# EasyEDA Pro project URADORRY-SUN.eprj, board Sub - MAX3421E/Rev1.0
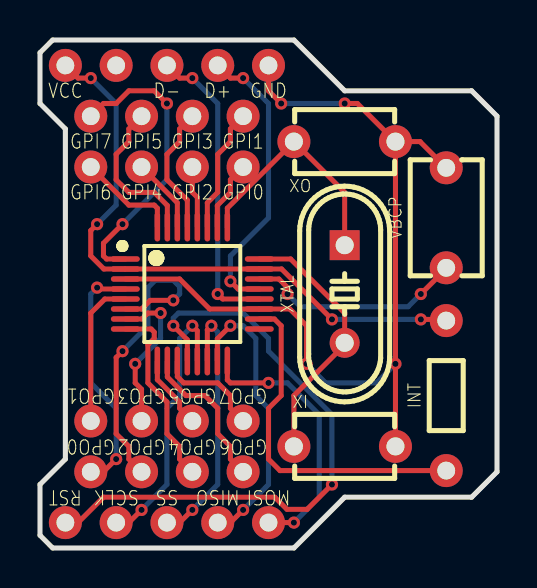
[diagram p4: board, top side]
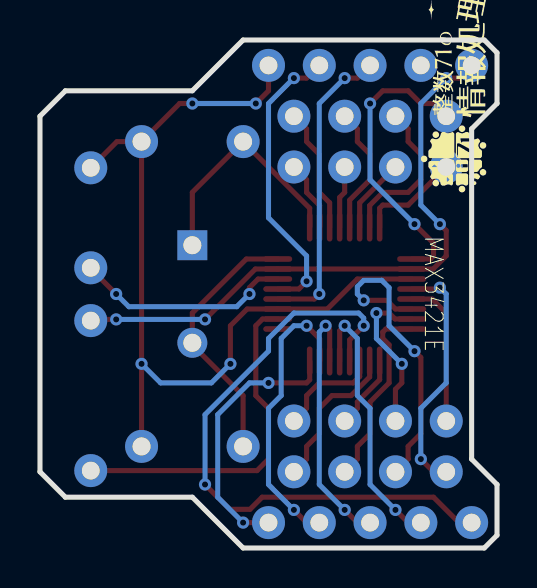
[diagram p5: board, bottom side, seen from below]

Outline 22.86 x 25.4 mm; copper layers: Top Layer, Bottom Layer. Coordinates in mm from the lower left corner of the outline.
Outline path: 0,24.77 0.63,25.4 12.7,25.4 15.24,22.86 21.59,22.86 22.86,21.59 22.86,3.81 21.59,2.54 15.24,2.54 12.7,0 0.63,0 0,0.64 0,3.17 1.27,4.45 1.27,20.95 0,22.23 0,24.77
Stack: Top Layer 0.035mm / Dielectric1 1.51mm FR4 er 4.5 / Bottom Layer 0.035mm

## Design rules (mm)
template: JLCPCB Capability(Two Layers Board)
spacing copperThickness1oz (default): track to track 0.102, other pairs 0.152 to 0.3
spacing copperThickness2oz: track to track 0.203, other pairs 0.152 to 0.3
track width copperThickness1oz (default): min 0.127, default 0.254, max 2.54
track width copperThickness2oz: min 0.203, default 0.254, max 2.54
differential pair differentialPair (default): width min 0.127, default 0.254, max 2.54; gap min 0.152, default 0.152
via viaSize (default): diameter min 0.5, default 0.61, max 10; hole min 0.3, default 0.305, max 6.3

## Placement (name value [footprint] x y rotation side)
INT  2.2kΩ  [res-th_bd1.7-l3.5-p7.50-d0.5]  20.32 7.62 270 top
MAX3421E  MAX3421EEHJ+T  [TQFP-32_L5.0-W5.0-P0.50-LS7.0-BL]  7.62 12.7 270 top
NOREF  -  [Pad_e85]  5.08 21.59 0 top
NOREF#2  -  [Pad_e86]  2.54 19.05 0 top
NOREF#3  -  [Pad_e91]  5.08 6.35 0 top
NOREF#4  -  [Pad_e82]  7.62 19.05 0 top
NOREF#5  -  [Pad_e93]  7.62 6.35 0 top
NOREF#6  -  [Pad_e1977]  3.81 24.13 0 top
NOREF#7  -  [Pad_e84]  5.08 19.05 0 top
NOREF#8  -  [Pad_e87]  2.54 21.59 0 top
NOREF#9  -  [Pad_e75]  11.43 1.27 0 top
NOREF#10  -  [Pad_e74]  1.27 24.13 0 top
NOREF#11  -  [Pad_e92]  7.62 3.81 0 top
NOREF#12  -  [Pad_e79]  1.27 1.27 0 top
NOREF#13  -  [Pad_e90]  5.08 3.81 0 top
NOREF#14  -  [Pad_e77]  6.35 1.27 0 top
NOREF#15  -  [Pad_e73]  11.43 24.13 0 top
NOREF#16  -  [Pad_e95]  10.16 6.35 0 top
NOREF#17  -  [Pad_e78]  3.81 1.27 0 top
NOREF#18  -  [Pad_e80]  10.16 19.05 0 top
NOREF#19  -  [Pad_e71]  8.89 24.13 0 top
NOREF#20  -  [Pad_e81]  10.16 21.59 0 top
NOREF#21  -  [Pad_e94]  10.16 3.81 0 top
NOREF#22  -  [Pad_e72]  6.35 24.13 0 top
NOREF#23  -  [Pad_e88]  2.54 6.35 0 top
NOREF#24  -  [Pad_e89]  2.54 3.81 0 top
NOREF#25  -  [Pad_e83]  7.62 21.59 0 top
NOREF#26  -  [Pad_e76]  8.89 1.27 0 top
VBCP  100nF  [cap-th_l5.8-w3.6-p5.0-d0.6]  20.32 16.51 270 top
XI  20pF  [cap-th_l5.0-w3.2-p5.08-d0.6]  15.24 5.08 180 top
XO  20pF  [cap-th_l5.0-w3.2-p5.08-d0.6]  15.24 20.32 180 top
XTAL  12MHz  [HC-49US_L11.5-W4.5-P4.88]  15.24 12.7 270 top

## Footprints (pads in the part's own frame, mm; a bottom-side part is the same pattern mirrored in y, then rotated)
cap-th_l5.0-w3.2-p5.08-d0.6
  round 1.651 hole 0.9x0.889: 1(-2.54,0) 2(2.54,0)
cap-th_l5.8-w3.6-p5.0-d0.6
  round 1.651 hole 0.889: 1(-2.5,0) 2(2.5,0)
HC-49US_L11.5-W4.5-P4.88
  rect 1.5x1.5 hole 0.9: 1(-2.44,0)
  round 1.5 hole 0.9: 2(2.44,0)
Pad_e71
  round 1.651 hole 0.889: 1(0,0)
Pad_e72
  round 1.651 hole 0.889: 1(0,0)
Pad_e73
  round 1.651 hole 0.889: 1(0,0)
Pad_e74
  round 1.651 hole 0.889: 1(0,0)
Pad_e75
  round 1.651 hole 0.889: 1(0,0)
Pad_e76
  round 1.651 hole 0.889: 1(0,0)
Pad_e77
  round 1.651 hole 0.889: 1(0,0)
Pad_e78
  round 1.651 hole 0.889: 1(0,0)
Pad_e79
  round 1.651 hole 0.889: 1(0,0)
Pad_e80
  round 1.651 hole 0.889: 1(0,0)
Pad_e81
  round 1.651 hole 0.889: 1(0,0)
Pad_e82
  round 1.651 hole 0.889: 1(0,0)
Pad_e83
  round 1.651 hole 0.889: 1(0,0)
Pad_e84
  round 1.651 hole 0.889: 1(0,0)
Pad_e85
  round 1.651 hole 0.889: 1(0,0)
Pad_e86
  round 1.651 hole 0.889: 1(0,0)
Pad_e87
  round 1.651 hole 0.889: 1(0,0)
Pad_e88
  round 1.651 hole 0.889: 1(0,0)
Pad_e89
  round 1.651 hole 0.889: 1(0,0)
Pad_e90
  round 1.651 hole 0.889: 1(0,0)
Pad_e91
  round 1.651 hole 0.889: 1(0,0)
Pad_e92
  round 1.651 hole 0.889: 1(0,0)
Pad_e93
  round 1.651 hole 0.889: 1(0,0)
Pad_e94
  round 1.651 hole 0.889: 1(0,0)
Pad_e95
  round 1.651 hole 0.889: 1(0,0)
Pad_e1977
  round 1.651 hole 0.889: 1(0,0)
res-th_bd1.7-l3.5-p7.50-d0.5
  round 1.651 hole 0.889: 1(-3.75,0) 2(3.75,0)
TQFP-32_L5.0-W5.0-P0.50-LS7.0-BL
  oval 0.28x1.45 smd: 1(-1.75,-3.35) 2(-1.25,-3.35) 3(-0.75,-3.35) 4(-0.25,-3.35) 5(0.25,-3.35) 6(0.75,-3.35) 7(1.25,-3.35) 8(1.75,-3.35) 17(1.75,3.35) 18(1.25,3.35) 19(0.75,3.35) 20(0.25,3.35) 21(-0.25,3.35) 22(-0.75,3.35) 23(-1.25,3.35) 24(-1.75,3.35)
  oval 1.45x0.28 smd: 9(3.35,-1.75) 10(3.35,-1.25) 11(3.35,-0.75) 12(3.35,-0.25) 13(3.35,0.25) 14(3.35,0.75) 15(3.35,1.25) 16(3.35,1.75) 25(-3.35,1.75) 26(-3.35,1.25) 27(-3.35,0.75) 28(-3.35,0.25) 29(-3.35,-0.25) 30(-3.35,-0.75) 31(-3.35,-1.25) 32(-3.35,-1.75)

## Nets
GND: MAX3421E.3 MAX3421E.19 NOREF#15.1 VBCP.1 XI.1 XO.1
+3.3V/MX: INT.1 MAX3421E.2 MAX3421E.23 NOREF#10.1
D+/MX: MAX3421E.21 NOREF#19.1
D-/MX: MAX3421E.20 NOREF#22.1
GPI0: MAX3421E.26 NOREF#18.1
GPI1: MAX3421E.27 NOREF#20.1
GPI2: MAX3421E.28 NOREF#4.1
GPI3: MAX3421E.29 NOREF#25.1
GPI4: MAX3421E.30 NOREF#7.1
GPI5: MAX3421E.31 NOREF.1
GPI6: MAX3421E.32 NOREF#2.1
GPI7: MAX3421E.1 NOREF#8.1
GPO0: MAX3421E.4 NOREF#24.1
GPO1: MAX3421E.5 NOREF#23.1
GPO2: MAX3421E.6 NOREF#13.1
GPO3: MAX3421E.7 NOREF#3.1
GPO4: MAX3421E.8 NOREF#11.1
GPO5: MAX3421E.9 NOREF#5.1
GPO6: MAX3421E.10 NOREF#21.1
GPO7: MAX3421E.11 NOREF#16.1
INT: INT.2 MAX3421E.18
MISO/MX: MAX3421E.15 NOREF#26.1
MOSI/MX: MAX3421E.16 NOREF#9.1
RST/MX: MAX3421E.12 NOREF#12.1
SCLK/MX: MAX3421E.13 NOREF#17.1
SS/MX: MAX3421E.14 NOREF#14.1
VBCP: MAX3421E.22 VBCP.2
XI: MAX3421E.24 XI.2 XTAL.2
XO: MAX3421E.25 XO.2 XTAL.1

Pads without a net: MAX3421E 17; NOREF#6 1

## Via types
v1: diameter 0.61, hole 0.305, Top Layer to Bottom Layer, 32 vias

## Routing (per net, layer and track width the routed paths; a pad name or vN(x,y) marks a point on that pad's centre or on a via; arc(x,y) is an arc through that point)
GND: length 44.2
  Top Layer w0.254: XI.1 v1(17.78,9.21) XO.1 ; XO.1 19.01,20.32 VBCP.1 ; XO.1 15.88,22.23 v1(15.24,22.23) ; MAX3421E.3 6.99,13.45 8.49,11.95 MAX3421E.19 12.5,11.95 13.34,11.11 v1(13.34,9.21) ; NOREF#15.1 11.43,22.86 v1(12.06,22.23)
  Bottom Layer w0.254: v1(17.78,9.21) 16.83,8.26 14.29,8.26 v1(13.34,9.21) ; v1(12.06,22.23) v1(15.24,22.23)
+3.3V/MX: length 30.6
  Top Layer w0.254: NOREF#10.1 1.91,23.5 v1(2.54,23.5) ; v1(14.61,11.43) 12.09,13.95 MAX3421E.23 MAX3421E.2 3.19,13.95 2.54,14.61 2.54,15.88 v1(2.86,16.19) ; INT.1 20.26,11.43 v1(19.05,11.43)
  Bottom Layer w0.254: v1(2.86,16.19) 3.81,17.14 3.81,22.23 v1(2.54,23.5) ; v1(14.61,11.43) v1(19.05,11.43)
D+/MX: length 14.6
  Top Layer w0.254: NOREF#19.1 9.53,23.5 v1(10.16,23.5) ; v1(9.53,13.34) 9.91,12.95 MAX3421E.21
  Bottom Layer w0.254: v1(10.16,23.5) 11.43,22.23 11.43,16.51 9.53,14.61 v1(9.53,13.34)
D-/MX: length 15
  Top Layer w0.254: v1(7.62,23.5) 6.99,23.5 NOREF#22.1 ; v1(8.89,12.7) 9.14,12.45 MAX3421E.20
  Bottom Layer w0.254: v1(7.62,23.5) 8.89,22.23 v1(8.89,12.7)
GPI0: length 3.5
  Top Layer w0.254: MAX3421E.26 8.87,17.12 9.53,17.78 9.53,18.42 NOREF#18.1
GPI1: length 6.3
  Top Layer w0.254: NOREF#20.1 9.53,20.95 9.53,20.32 8.89,19.69 8.89,17.78 8.37,17.26 MAX3421E.27
GPI2: length 3.1
  Top Layer w0.254: NOREF#4.1 7.62,17.78 7.87,17.53 MAX3421E.28
GPI3: length 6.5
  Top Layer w0.254: MAX3421E.29 7.37,17.39 6.35,18.42 6.35,19.69 6.99,20.32 6.99,20.95 NOREF#25.1
GPI4: length 3.7
  Top Layer w0.254: NOREF#7.1 6.87,17.26 MAX3421E.30
GPI5: length 7.9
  Top Layer w0.254: MAX3421E.31 6.37,17.12 5.72,17.78 4.44,17.78 3.81,18.42 3.81,19.69 4.44,20.32 4.44,20.95 NOREF.1
GPI6: length 5.1
  Top Layer w0.254: MAX3421E.32 5.87,16.99 5.72,17.14 4.44,17.14 NOREF#2.1
GPI7: length 14.7
  Top Layer w0.254: v1(6.35,22.23) 5.72,22.86 4.44,22.86 3.81,22.23 3.18,22.23 NOREF#8.1 ; v1(4.13,16.19) 3.18,15.24 3.18,14.61 3.33,14.45 MAX3421E.1
  Bottom Layer w0.254: v1(4.13,16.19) 6.35,18.42 v1(6.35,22.23)
GPO0: length 12.2
  Top Layer w0.254: NOREF#24.1 3.18,3.81 v1(3.81,4.45) ; v1(2.86,13.02) 2.93,12.95 MAX3421E.4
  Bottom Layer w0.254: v1(3.81,4.45) 3.81,6.98 2.54,8.26 2.54,12.7 v1(2.86,13.02)
GPO1: length 7.4
  Top Layer w0.254: MAX3421E.5 3.24,12.45 2.54,11.75 NOREF#23.1
GPO2: length 15.7
  Top Layer w0.254: v1(4.13,9.84) 3.81,9.53 3.81,5.72 4.44,5.08 4.44,4.45 NOREF#13.1 ; MAX3421E.6 5.08,11.95 5.51,12.38 v1(6.67,12.38)
  Bottom Layer w0.254: v1(6.67,12.38) 6.99,12.7 6.99,13.06 6.67,13.38 5.76,13.38 5.4,13.02 5.4,11.11 v1(4.13,9.84)
GPO3: length 7.9
  Top Layer w0.254: v1(6.03,11.75) 5.4,11.75 5.1,11.45 MAX3421E.7 ; NOREF#3.1 5.08,7.94 4.76,8.26 v1(4.76,9.21)
  Bottom Layer w0.254: v1(4.76,9.21) 6.03,10.48 v1(6.03,11.75)
GPO4: length 9.5
  Top Layer w0.254: MAX3421E.8 5.56,10.95 5.72,10.8 5.72,10.48 5.4,10.16 5.4,8.26 6.35,7.3 6.35,5.72 6.99,5.08 6.99,4.45 NOREF#11.1
GPO5: length 3.7
  Top Layer w0.254: NOREF#5.1 6.99,6.98 6.99,7.3 5.87,8.42 MAX3421E.9
GPO6: length 7.7
  Top Layer w0.254: NOREF#21.1 9.53,4.45 9.53,5.08 8.89,5.72 8.89,6.98 8.25,7.62 7.3,7.62 6.37,8.55 MAX3421E.10
GPO7: length 5.4
  Top Layer w0.254: NOREF#16.1 9.53,6.98 9.53,7.62 8.89,8.26 7.19,8.26 6.87,8.57 MAX3421E.11
INT: length 17.3
  Top Layer w0.254: MAX3421E.18 11.73,11.45 12.06,11.11 12.06,7.62 11.43,6.98 11.43,4.45 12,3.87 INT.2
MISO/MX: length 14.5
  Top Layer w0.254: MAX3421E.15 8.87,10.46 v1(9.53,11.11) ; v1(10.16,1.91) 9.53,1.27 NOREF#26.1
  Bottom Layer w0.254: v1(10.16,1.91) 11.43,3.17 11.43,6.98 10.8,7.62 10.8,10.48 10.16,11.11 v1(9.53,11.11)
MOSI/MX: length 13.5
  Top Layer w0.254: MAX3421E.16 9.37,8.41 9.53,8.26 v1(11.43,8.26) ; v1(12.7,1.27) NOREF#9.1
  Bottom Layer w0.254: v1(11.43,8.26) 12.38,8.26 13.97,6.67 13.97,2.54 v1(12.7,1.27)
RST/MX: length 31.1
  Top Layer w0.254: v1(14.61,3.17) 13.36,1.93 12.35,1.93 11.75,2.54 3.18,2.54 1.91,1.27 NOREF#12.1 ; v1(6.67,11.11) 7.37,10.41 MAX3421E.12
  Bottom Layer w0.254: v1(14.61,3.17) 14.61,6.67 11.43,9.84 11.43,10.48 10.16,11.75 6.92,11.75 6.67,11.49 v1(6.67,11.11)
SCLK/MX: length 13.7
  Top Layer w0.254: MAX3421E.13 7.87,10.86 v1(7.62,11.11) ; v1(5.08,1.91) 4.44,1.27 NOREF#17.1
  Bottom Layer w0.254: v1(5.08,1.91) 6.35,3.17 6.35,6.98 6.99,7.62 6.99,10.48 v1(7.62,11.11)
SS/MX: length 13.2
  Top Layer w0.254: MAX3421E.14 8.37,10.91 v1(8.57,11.11) ; NOREF#14.1 6.99,1.27 v1(7.62,1.91)
  Bottom Layer w0.254: v1(8.57,11.11) 8.89,10.8 8.89,3.17 v1(7.62,1.91)
VBCP: length 10.9
  Top Layer w0.254: v1(12.38,12.7) 12.38,13.02 11.95,13.45 MAX3421E.22 ; v1(19.05,12.7) 20.32,13.97 VBCP.2
  Bottom Layer w0.254: v1(12.38,12.7) 13.02,12.06 18.41,12.06 v1(19.05,12.7)
XI: length 13.1
  Top Layer w0.254: XI.2 12.7,7.62 15.24,10.16 XTAL.2 15.24,11.75 12.54,14.45 MAX3421E.24
XO: length 11.9
  Top Layer w0.254: XTAL.1 15.24,17.78 XO.2 9.37,16.99 MAX3421E.25

## Text on the board
Bottom Silkscreen Layer: MAX3421E
Top Silkscreen Layer: VCC | GPI7 | GPI6 | GPI5 | GPI4 | D- | GPI3 | GPI2 | D+ | GPI1 | GPI0 | GND | RST | GPO1 | GPO0 | SCLK | GPO3 | GPO2 | SS | GPO5 | GPO4 | MISO | GPO7 | GPO6 | MOSI
